# EasyEDA Pro project PR.eprj, schematic 新大符2.0 (continued)
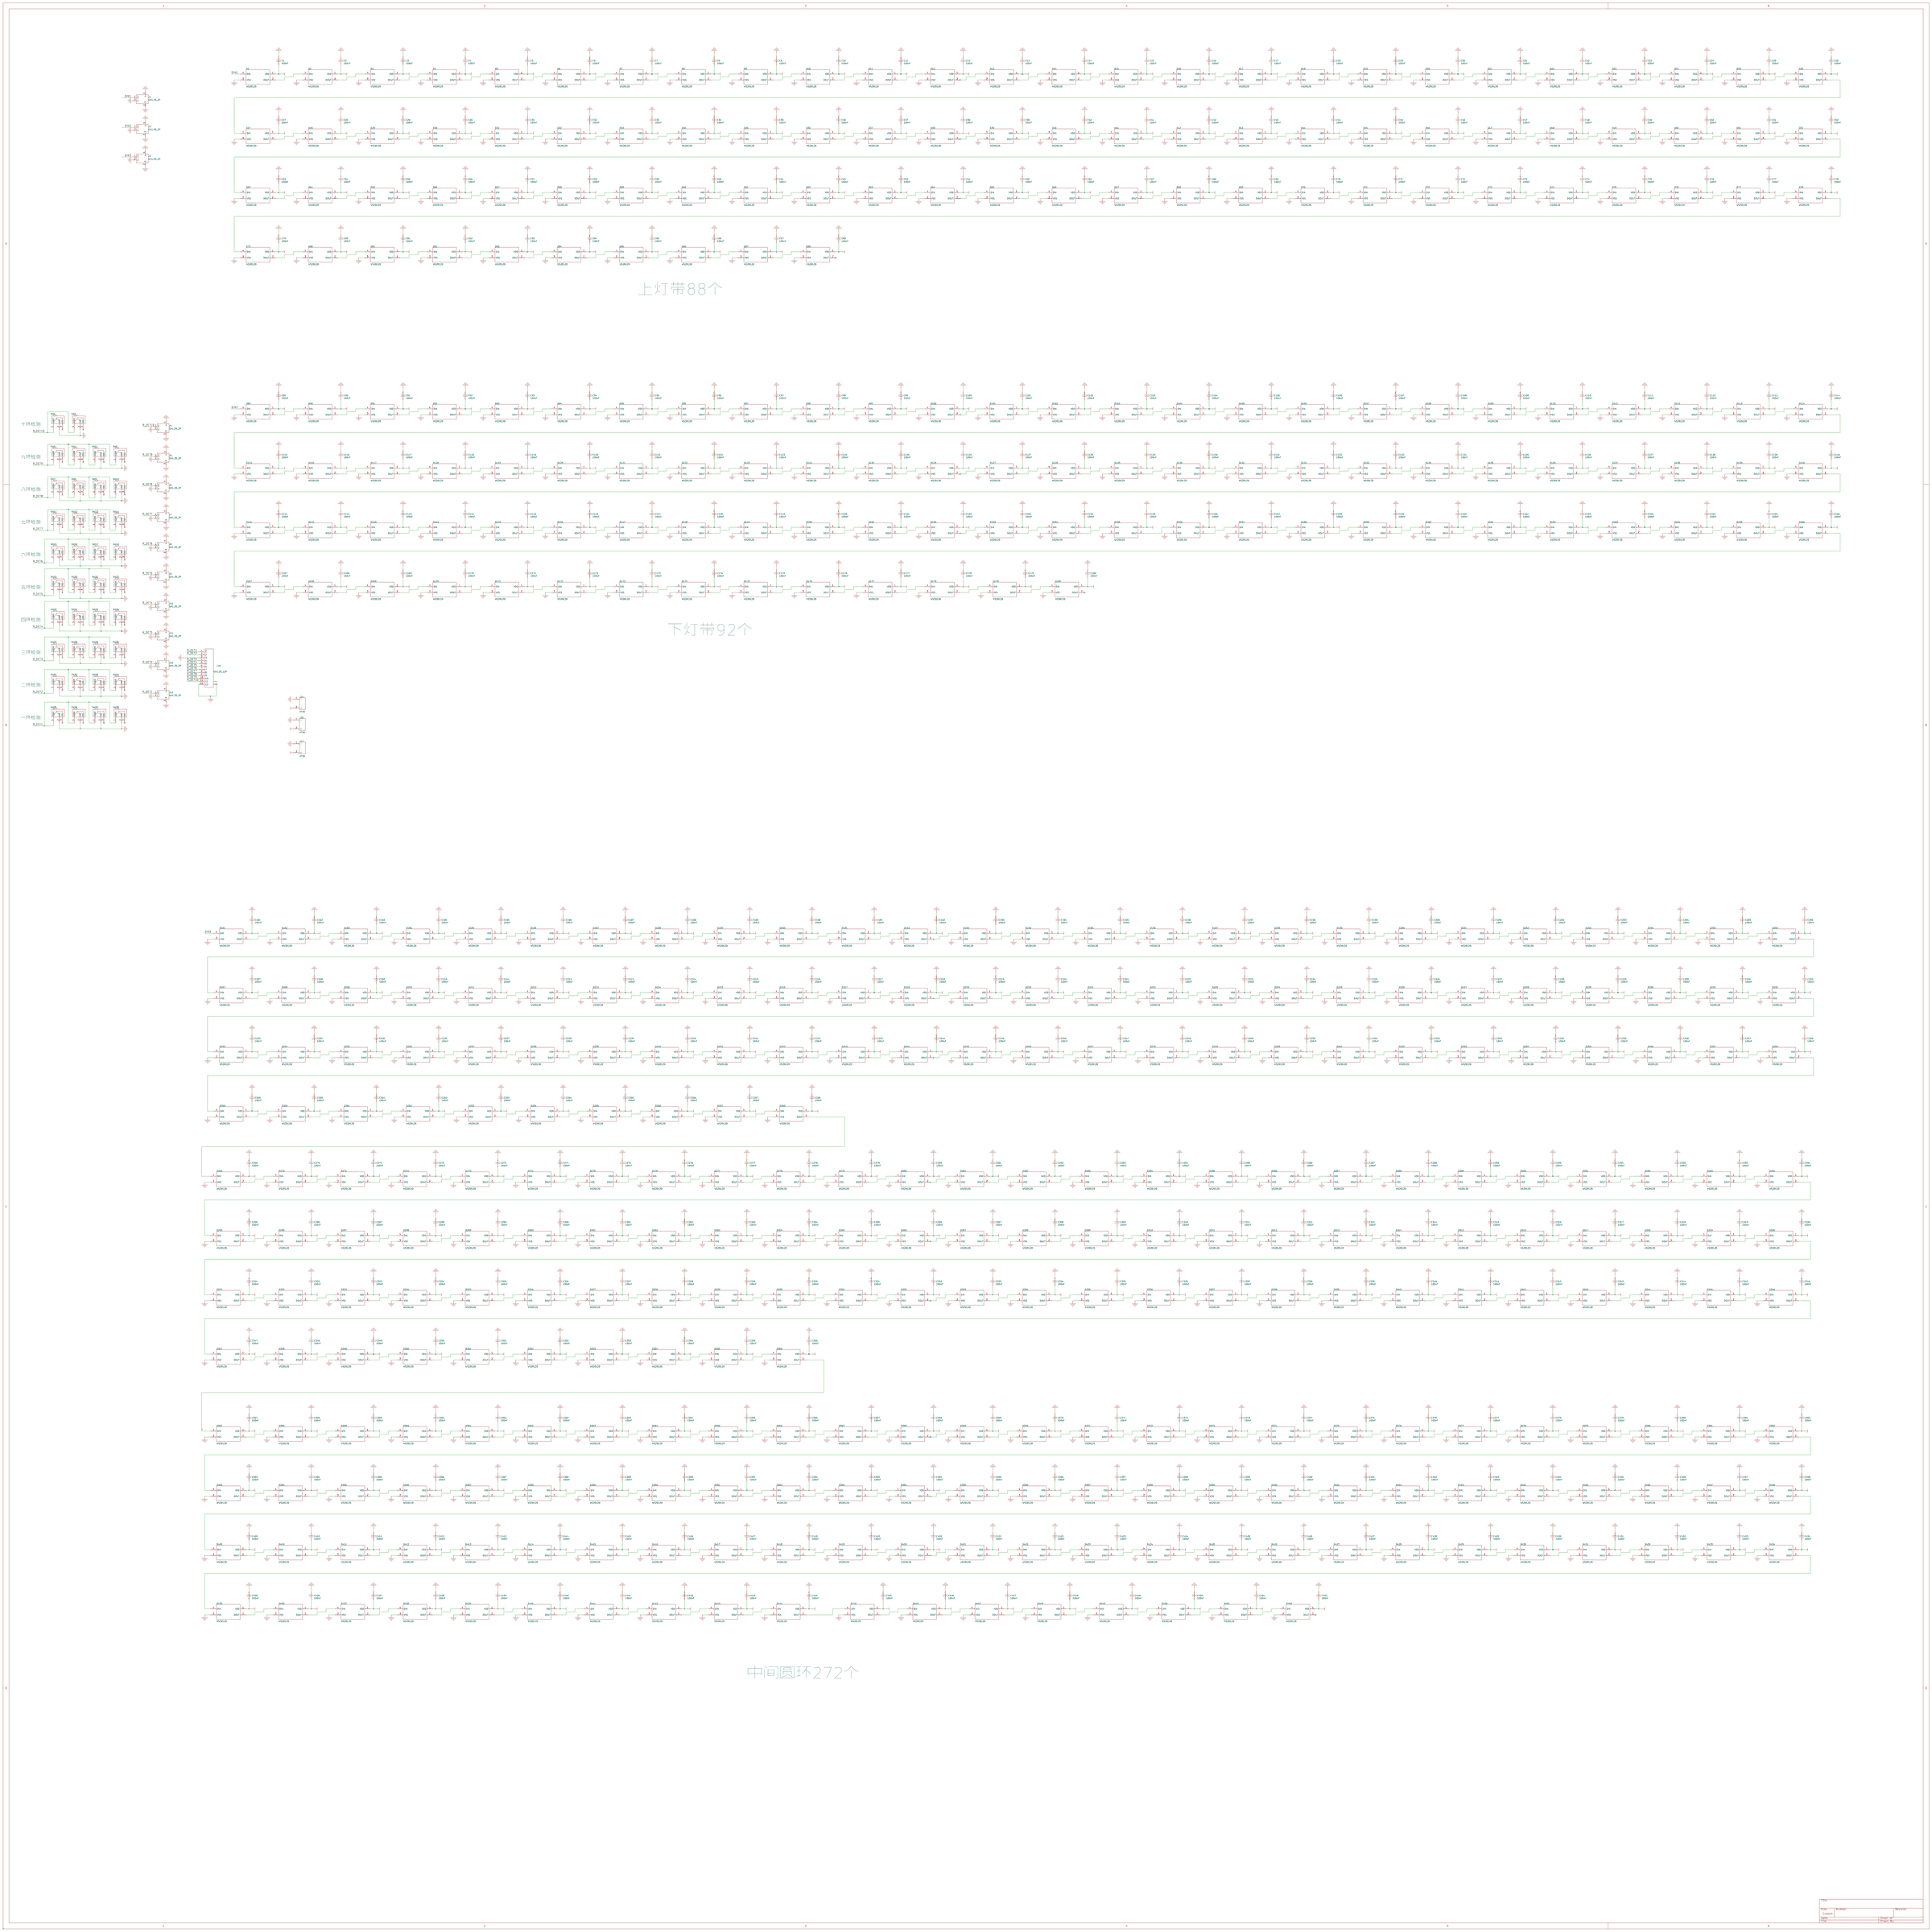
[diagram p0: schematic sheet]
## Nets (continued)
VCC: C1.1 C2.1 C3.1 C4.1 C5.1 C6.1 C7.1 C8.1 C9.1 C10.1 C11.1 C12.1 C13.1 C14.1 C15.1 C16.1 C17.1 C18.1 C19.1 C20.1 C21.1 C22.1 C23.1 C24.1 C25.1 C26.1 C27.1 C28.1 C29.1 C30.1 C31.1 C32.1 C33.1 C34.1 C35.1 C36.1 C37.1 C38.1 C39.1 C40.1 C41.1 C42.1 C43.1 C44.1 C45.1 C46.1 C47.1 C48.1 C49.1 C50.1 C51.1 C52.1 C53.1 C54.1 C55.1 C56.1 C57.1 C58.1 C59.1 C60.1 C61.1 C62.1 C63.1 C64.1 C65.1 C66.1 C67.1 C68.1 C69.1 C70.1 C71.1 C72.1 C73.1 C74.1 C75.1 C76.1 C77.1 C78.1 C79.1 C80.1 C81.1 C82.1 C83.1 C84.1 C85.1 C86.1 C87.1 C88.1 C89.1 C90.1 C91.1 C92.1 C93.1 C94.1 C95.1 C96.1 C97.1 C98.1 C99.1 C100.1 C101.1 C102.1 C103.1 C104.1 C105.1 C106.1 C107.1 C108.1 C109.1 C110.1 C111.1 C112.1 C113.1 C114.1 C115.1 C116.1 C117.1 C118.1 C119.1 C120.1 C121.1 C122.1 C123.1 C124.1 C125.1 C126.1 C127.1 C128.1 C129.1 C130.1 C131.1 C132.1 C133.1 C134.1 C135.1 C136.1 C137.1 C138.1 C139.1 C140.1 C141.1 C142.1 C143.1 C144.1 C145.1 C146.1 C147.1 C148.1 C149.1 C150.1 C151.1 C152.1 C153.1 C154.1 C155.1 C156.1 C157.1 C158.1 C159.1 C160.1 C161.1 C162.1 C163.1 C164.1 C165.1 C166.1 C167.1 C168.1 C169.1 C170.1 C171.1 C172.1 C173.1 C174.1 C175.1 C176.1 C177.1 C178.1 C179.1 C180.1 C181.1 C182.1 C183.1 C184.1 C185.1 C186.1 C187.1 C188.1 C189.1 C190.1 C191.1 C192.1 C193.1 C194.1 C195.1 C196.1 C197.1 C198.1 C199.1 C200.1 C201.1 C202.1 C203.1 C204.1 C205.1 C206.1 C207.1 C208.1 C209.1 C210.1 C211.1 C212.1 C213.1 C214.1 C215.1 C216.1 C217.1 C218.1 C219.1 C220.1 C221.1 C222.1 C223.1 C224.1 C225.1 C226.1 C227.1 C228.1 C229.1 C230.1 C231.1 C232.1 C233.1 C234.1 C235.1 C236.1 C237.1 C238.1 C239.1 C240.1 C241.1 C242.1 C243.1 C244.1 C245.1 C246.1 C247.1 C248.1 C249.1 C250.1 C251.1 C252.1 C253.1 C254.1 C255.1 C256.1 C257.1 C258.1 C259.1 C260.1 C261.1 C262.1 C263.1 C264.1 C265.1 C266.1 C267.1 C268.1 C269.1 C270.1 C271.1 C272.1 C273.1 C274.1 C275.1 C276.1 C277.1 C278.1 C279.1 C280.1 C281.1 C282.1 C283.1 C284.1 C285.1 C286.1 C287.1 C288.1 C289.1 C290.1 C291.1 C292.1 C293.1 C294.1 C295.1 C296.1 C297.1 C298.1 C299.1 C300.1 C301.1 C302.1 C303.1 C304.1 C305.1 C306.1 C307.1 C308.1 C309.1 C310.1 C311.1 C312.1 C313.1 C314.1 C315.1 C316.1 C317.1 C318.1 C319.1 C320.1 C321.1 C322.1 C323.1 C324.1 C325.1 C326.1 C327.1 C328.1 C329.1 C330.1 C331.1 C332.1 C333.1 C334.1 C335.1 C336.1 C337.1 C338.1 C339.1 C340.1 C341.1 C342.1 C343.1 C344.1 C345.1 C346.1 C347.1 C348.1 C349.1 C350.1 C351.1 C352.1 C353.1 C354.1 C355.1 C356.1 C357.1 C358.1 C359.1 C360.1 C361.1 C362.1 C363.1 C364.1 C365.1 C366.1 C367.1 C368.1 C369.1 C370.1 C371.1 C372.1 C373.1 C374.1 C375.1 C376.1 C377.1 C378.1 C379.1 C380.1 C381.1 C382.1 C383.1 C384.1 C385.1 C386.1 C387.1 C388.1 C389.1 C390.1 C391.1 C392.1 C393.1 C394.1 C395.1 C396.1 C397.1 C398.1 C399.1 C400.1 C401.1 C402.1 C403.1 C404.1 C405.1 C406.1 C407.1 C408.1 C409.1 C410.1 C411.1 C412.1 C413.1 C414.1 C415.1 C416.1 C417.1 C418.1 C419.1 C420.1 C421.1 C422.1 C423.1 C424.1 C425.1 C426.1 C427.1 C428.1 C429.1 C430.1 C431.1 C432.1 C433.1 C434.1 C435.1 C436.1 C437.1 C438.1 C439.1 C440.1 C441.1 C442.1 C443.1 C444.1 C445.1 C446.1 C447.1 C448.1 C449.1 C450.1 C451.1 C452.1 D1.1(VDD) D2.1(VDD) D3.1(VDD) D4.1(VDD) D5.1(VDD) D6.1(VDD) D7.1(VDD) D8.1(VDD) D9.1(VDD) D10.1(VDD) D11.1(VDD) D12.1(VDD) D13.1(VDD) D14.1(VDD) D15.1(VDD) D16.1(VDD) D17.1(VDD) D18.1(VDD) D19.1(VDD) D20.1(VDD) D21.1(VDD) D22.1(VDD) D23.1(VDD) D24.1(VDD) D25.1(VDD) D26.1(VDD) D27.1(VDD) D28.1(VDD) D29.1(VDD) D30.1(VDD) D31.1(VDD) D32.1(VDD) D33.1(VDD) D34.1(VDD) D35.1(VDD) D36.1(VDD) D37.1(VDD) D38.1(VDD) D39.1(VDD) D40.1(VDD) D41.1(VDD) D42.1(VDD) D43.1(VDD) D44.1(VDD) D45.1(VDD) D46.1(VDD) D47.1(VDD) D48.1(VDD) D49.1(VDD) D50.1(VDD) D51.1(VDD) D52.1(VDD) D53.1(VDD) D54.1(VDD) D55.1(VDD) D56.1(VDD) D57.1(VDD) D58.1(VDD) D59.1(VDD) D60.1(VDD) D61.1(VDD) D62.1(VDD) D63.1(VDD) D64.1(VDD) D65.1(VDD) D66.1(VDD) D67.1(VDD) D68.1(VDD) D69.1(VDD) D70.1(VDD) D71.1(VDD) D72.1(VDD) D73.1(VDD) D74.1(VDD) D75.1(VDD) D76.1(VDD) D77.1(VDD) D78.1(VDD) D79.1(VDD) D80.1(VDD) D81.1(VDD) D82.1(VDD) D83.1(VDD) D84.1(VDD) D85.1(VDD) D86.1(VDD) D87.1(VDD) D88.1(VDD) D89.1(VDD) D90.1(VDD) D91.1(VDD) D92.1(VDD) D93.1(VDD) D94.1(VDD) D95.1(VDD) D96.1(VDD) D97.1(VDD) D98.1(VDD) D99.1(VDD) D100.1(VDD) D101.1(VDD) D102.1(VDD) D103.1(VDD) D104.1(VDD) D105.1(VDD) D106.1(VDD) D107.1(VDD) D108.1(VDD) D109.1(VDD) D110.1(VDD) D111.1(VDD) D112.1(VDD) D113.1(VDD) D114.1(VDD) D115.1(VDD) D116.1(VDD) D117.1(VDD) D118.1(VDD) D119.1(VDD) D120.1(VDD) D121.1(VDD) D122.1(VDD) D123.1(VDD) D124.1(VDD) D125.1(VDD) D126.1(VDD) D127.1(VDD) D128.1(VDD) D129.1(VDD) D130.1(VDD) D131.1(VDD) D132.1(VDD) D133.1(VDD) D134.1(VDD) D135.1(VDD) D136.1(VDD) D137.1(VDD) D138.1(VDD) D139.1(VDD) D140.1(VDD) D141.1(VDD) D142.1(VDD) D143.1(VDD) D144.1(VDD) D145.1(VDD) D146.1(VDD) D147.1(VDD) D148.1(VDD) D149.1(VDD) D150.1(VDD) D151.1(VDD) D152.1(VDD) D153.1(VDD) D154.1(VDD) D155.1(VDD) D156.1(VDD) D157.1(VDD) D158.1(VDD) D159.1(VDD) D160.1(VDD) D161.1(VDD) D162.1(VDD) D163.1(VDD) D164.1(VDD) D165.1(VDD) D166.1(VDD) D167.1(VDD) D168.1(VDD) D169.1(VDD) D170.1(VDD) D171.1(VDD) D172.1(VDD) D173.1(VDD) D174.1(VDD) D175.1(VDD) D176.1(VDD) D177.1(VDD) D178.1(VDD) D179.1(VDD) D180.1(VDD) D181.1(VDD) D182.1(VDD) D183.1(VDD) D184.1(VDD) D185.1(VDD) D186.1(VDD) D187.1(VDD) D188.1(VDD) D189.1(VDD) D190.1(VDD) D191.1(VDD) D192.1(VDD) D193.1(VDD) D194.1(VDD) D195.1(VDD) D196.1(VDD) D197.1(VDD) D198.1(VDD) D199.1(VDD) D200.1(VDD) D201.1(VDD) D202.1(VDD) D203.1(VDD) D204.1(VDD) D205.1(VDD) D206.1(VDD) D207.1(VDD) D208.1(VDD) D209.1(VDD) D210.1(VDD) D211.1(VDD) D212.1(VDD) D213.1(VDD) D214.1(VDD) D215.1(VDD) D216.1(VDD) D217.1(VDD) D218.1(VDD) D219.1(VDD) D220.1(VDD) D221.1(VDD) D222.1(VDD) D223.1(VDD) D224.1(VDD) D225.1(VDD) D226.1(VDD) D227.1(VDD) D228.1(VDD) D229.1(VDD) D230.1(VDD) D231.1(VDD) D232.1(VDD) D233.1(VDD) D234.1(VDD) D235.1(VDD) D236.1(VDD) D237.1(VDD) D238.1(VDD) D239.1(VDD) D240.1(VDD) D241.1(VDD) D242.1(VDD) D243.1(VDD) D244.1(VDD) D245.1(VDD) D246.1(VDD) D247.1(VDD) D248.1(VDD) D249.1(VDD) D250.1(VDD) D251.1(VDD) D252.1(VDD) D253.1(VDD) D254.1(VDD) D255.1(VDD) D256.1(VDD) D257.1(VDD) D258.1(VDD) D259.1(VDD) D260.1(VDD) D261.1(VDD) D262.1(VDD) D263.1(VDD) D264.1(VDD) D265.1(VDD) D266.1(VDD) D267.1(VDD) D268.1(VDD) D269.1(VDD) D270.1(VDD) D271.1(VDD) D272.1(VDD) D273.1(VDD) D274.1(VDD) D275.1(VDD) D276.1(VDD) D277.1(VDD) D278.1(VDD) D279.1(VDD) D280.1(VDD) D281.1(VDD) D282.1(VDD) D283.1(VDD) D284.1(VDD) D285.1(VDD) D286.1(VDD) D287.1(VDD) D288.1(VDD) D289.1(VDD) D290.1(VDD) D291.1(VDD) D292.1(VDD) D293.1(VDD) D294.1(VDD) D295.1(VDD) D296.1(VDD) D297.1(VDD) D298.1(VDD) D299.1(VDD) D300.1(VDD) D301.1(VDD) D302.1(VDD) D303.1(VDD) D304.1(VDD) D305.1(VDD) D306.1(VDD) D307.1(VDD) D308.1(VDD) D309.1(VDD) D310.1(VDD) D311.1(VDD) D312.1(VDD) D313.1(VDD) D314.1(VDD) D315.1(VDD) D316.1(VDD) D317.1(VDD) D318.1(VDD) D319.1(VDD) D320.1(VDD) D321.1(VDD) D322.1(VDD) D323.1(VDD) D324.1(VDD) D325.1(VDD) D326.1(VDD) D327.1(VDD) D328.1(VDD) D329.1(VDD) D330.1(VDD) D331.1(VDD) D332.1(VDD) D333.1(VDD) D334.1(VDD) D335.1(VDD) D336.1(VDD) D337.1(VDD) D338.1(VDD) D339.1(VDD) D340.1(VDD) D341.1(VDD) D342.1(VDD) D343.1(VDD) D344.1(VDD) D345.1(VDD) D346.1(VDD) D347.1(VDD) D348.1(VDD) D349.1(VDD) D350.1(VDD) D351.1(VDD) D352.1(VDD) D353.1(VDD) D354.1(VDD) D355.1(VDD) D356.1(VDD) D357.1(VDD) D358.1(VDD) D359.1(VDD) D360.1(VDD) D361.1(VDD) D362.1(VDD) D363.1(VDD) D364.1(VDD) D365.1(VDD) D366.1(VDD) D367.1(VDD) D368.1(VDD) D369.1(VDD) D370.1(VDD) D371.1(VDD) D372.1(VDD) D373.1(VDD) D374.1(VDD) D375.1(VDD) D376.1(VDD) D377.1(VDD) D378.1(VDD) D379.1(VDD) D380.1(VDD) D381.1(VDD) D382.1(VDD) D383.1(VDD) D384.1(VDD) D385.1(VDD) D386.1(VDD) D387.1(VDD) D388.1(VDD) D389.1(VDD) D390.1(VDD) D391.1(VDD) D392.1(VDD) D393.1(VDD) D394.1(VDD) D395.1(VDD) D396.1(VDD) D397.1(VDD) D398.1(VDD) D399.1(VDD) D400.1(VDD) D401.1(VDD) D402.1(VDD) D403.1(VDD) D404.1(VDD) D405.1(VDD) D406.1(VDD) D407.1(VDD) D408.1(VDD) D409.1(VDD) D410.1(VDD) D411.1(VDD) D412.1(VDD) D413.1(VDD) D414.1(VDD) D415.1(VDD) D416.1(VDD) D417.1(VDD) D418.1(VDD) D419.1(VDD) D420.1(VDD) D421.1(VDD) D422.1(VDD) D423.1(VDD) D424.1(VDD) D425.1(VDD) D426.1(VDD) D427.1(VDD) D428.1(VDD) D429.1(VDD) D430.1(VDD) D431.1(VDD) D432.1(VDD) D433.1(VDD) D434.1(VDD) D435.1(VDD) D436.1(VDD) D437.1(VDD) D438.1(VDD) D439.1(VDD) D440.1(VDD) D441.1(VDD) D442.1(VDD) D443.1(VDD) D444.1(VDD) D445.1(VDD) D446.1(VDD) D447.1(VDD) D448.1(VDD) D449.1(VDD) D450.1(VDD) D451.1(VDD) D452.1(VDD) J14.2(+) J15.2(+) J17.2(+)
DIN1: D1.4(DIN) J1.1
DIN2: D89.4(DIN) J2.1
DIN3: D181.4(DIN) J3.1
I: D356.2(DOUT) D357.4(DIN)
R_DET1: J13.1 J18.1 SW35.1(COM) SW36.1(COM) SW37.1(COM) SW38.1(COM)
R_DET2: J12.1 J18.2 SW31.1(COM) SW32.1(COM) SW33.1(COM) SW34.1(COM)
R_DET3: J11.1 J18.4 SW27.1(COM) SW28.1(COM) SW29.1(COM) SW30.1(COM)
R_DET4: J10.1 J18.5 SW23.1(COM) SW24.1(COM) SW25.1(COM) SW26.1(COM)
R_DET5: J9.1 J18.6 SW19.1(COM) SW20.1(COM) SW21.1(COM) SW22.1(COM)
R_DET6: J8.1 J18.7 SW15.1(COM) SW16.1(COM) SW17.1(COM) SW18.1(COM)
R_DET7: J7.1 J18.8 SW11.1(COM) SW12.1(COM) SW13.1(COM) SW14.1(COM)
R_DET8: J6.1 J18.9 SW7.1(COM) SW8.1(COM) SW9.1(COM) SW10.1(COM)
R_DET9: J5.1 J18.10 SW3.1(COM) SW4.1(COM) SW5.1(COM) SW6.1(COM)
R_DET10: J4.1 J18.11 SW1.1(COM) SW2.1(COM)
NETD1_2: D1.2(DOUT) D2.4(DIN)
NETD2_2: D2.2(DOUT) D3.4(DIN)
NETD3_2: D3.2(DOUT) D4.4(DIN)
NETD4_2: D4.2(DOUT) D5.4(DIN)
NETD5_2: D5.2(DOUT) D6.4(DIN)
NETD6_2: D6.2(DOUT) D7.4(DIN)
NETD7_2: D7.2(DOUT) D8.4(DIN)
NETD8_2: D8.2(DOUT) D9.4(DIN)
NETD9_2: D9.2(DOUT) D10.4(DIN)
NETD10_2: D10.2(DOUT) D11.4(DIN)
NETD11_2: D11.2(DOUT) D12.4(DIN)
NETD12_2: D12.2(DOUT) D13.4(DIN)
NETD13_2: D13.2(DOUT) D14.4(DIN)
NETD14_2: D14.2(DOUT) D15.4(DIN)
NETD15_2: D15.2(DOUT) D16.4(DIN)
NETD16_2: D16.2(DOUT) D17.4(DIN)
NETD17_2: D17.2(DOUT) D18.4(DIN)
NETD18_2: D18.2(DOUT) D19.4(DIN)
NETD19_2: D19.2(DOUT) D20.4(DIN)
NETD20_2: D20.2(DOUT) D21.4(DIN)
NETD21_2: D21.2(DOUT) D22.4(DIN)
NETD22_2: D22.2(DOUT) D23.4(DIN)
NETD23_2: D23.2(DOUT) D24.4(DIN)
NETD24_2: D24.2(DOUT) D25.4(DIN)
NETD25_2: D25.2(DOUT) D26.4(DIN)
NETD26_2: D26.2(DOUT) D27.4(DIN)
NETD27_2: D27.2(DOUT) D28.4(DIN)
NETD28_2: D28.2(DOUT) D29.4(DIN)
NETD29_2: D29.2(DOUT) D30.4(DIN)
NETD30_2: D30.2(DOUT) D31.4(DIN)
NETD31_2: D31.2(DOUT) D32.4(DIN)
NETD32_2: D32.2(DOUT) D33.4(DIN)
NETD33_2: D33.2(DOUT) D34.4(DIN)
NETD34_2: D34.2(DOUT) D35.4(DIN)
NETD35_2: D35.2(DOUT) D36.4(DIN)
NETD36_2: D36.2(DOUT) D37.4(DIN)
NETD37_2: D37.2(DOUT) D38.4(DIN)
NETD38_2: D38.2(DOUT) D39.4(DIN)
NETD39_2: D39.2(DOUT) D40.4(DIN)
NETD40_2: D40.2(DOUT) D41.4(DIN)
NETD41_2: D41.2(DOUT) D42.4(DIN)
NETD42_2: D42.2(DOUT) D43.4(DIN)
NETD43_2: D43.2(DOUT) D44.4(DIN)
NETD44_2: D44.2(DOUT) D45.4(DIN)
NETD45_2: D45.2(DOUT) D46.4(DIN)
NETD46_2: D46.2(DOUT) D47.4(DIN)
NETD47_2: D47.2(DOUT) D48.4(DIN)
NETD48_2: D48.2(DOUT) D49.4(DIN)
NETD49_2: D49.2(DOUT) D50.4(DIN)
NETD50_2: D50.2(DOUT) D51.4(DIN)
NETD51_2: D51.2(DOUT) D52.4(DIN)
NETD52_2: D52.2(DOUT) D53.4(DIN)
NETD53_2: D53.2(DOUT) D54.4(DIN)
NETD54_2: D54.2(DOUT) D55.4(DIN)
NETD55_2: D55.2(DOUT) D56.4(DIN)
NETD56_2: D56.2(DOUT) D57.4(DIN)
NETD57_2: D57.2(DOUT) D58.4(DIN)
NETD58_2: D58.2(DOUT) D59.4(DIN)
NETD59_2: D59.2(DOUT) D60.4(DIN)
NETD60_2: D60.2(DOUT) D61.4(DIN)
NETD61_2: D61.2(DOUT) D62.4(DIN)
NETD62_2: D62.2(DOUT) D63.4(DIN)
NETD63_2: D63.2(DOUT) D64.4(DIN)
NETD64_2: D64.2(DOUT) D65.4(DIN)
NETD65_2: D65.2(DOUT) D66.4(DIN)
NETD66_2: D66.2(DOUT) D67.4(DIN)
NETD67_2: D67.2(DOUT) D68.4(DIN)
NETD68_2: D68.2(DOUT) D69.4(DIN)
NETD69_2: D69.2(DOUT) D70.4(DIN)
NETD70_2: D70.2(DOUT) D71.4(DIN)
NETD71_2: D71.2(DOUT) D72.4(DIN)
NETD72_2: D72.2(DOUT) D73.4(DIN)
NETD73_2: D73.2(DOUT) D74.4(DIN)
NETD74_2: D74.2(DOUT) D75.4(DIN)
NETD75_2: D75.2(DOUT) D76.4(DIN)
NETD76_2: D76.2(DOUT) D77.4(DIN)
NETD77_2: D77.2(DOUT) D78.4(DIN)
NETD78_2: D78.2(DOUT) D79.4(DIN)
NETD79_2: D79.2(DOUT) D80.4(DIN)
NETD80_2: D80.2(DOUT) D81.4(DIN)
NETD81_2: D81.2(DOUT) D82.4(DIN)
NETD82_2: D82.2(DOUT) D83.4(DIN)
NETD83_2: D83.2(DOUT) D84.4(DIN)
NETD84_2: D84.2(DOUT) D85.4(DIN)
NETD85_2: D85.2(DOUT) D86.4(DIN)
NETD86_2: D86.2(DOUT) D87.4(DIN)
NETD87_2: D87.2(DOUT) D88.4(DIN)
NETD89_2: D89.2(DOUT) D90.4(DIN)
NETD90_2: D90.2(DOUT) D91.4(DIN)
NETD91_2: D91.2(DOUT) D92.4(DIN)
NETD92_2: D92.2(DOUT) D93.4(DIN)
NETD93_2: D93.2(DOUT) D94.4(DIN)
NETD94_2: D94.2(DOUT) D95.4(DIN)
NETD95_2: D95.2(DOUT) D96.4(DIN)
NETD96_2: D96.2(DOUT) D97.4(DIN)
NETD97_2: D97.2(DOUT) D98.4(DIN)
NETD98_2: D98.2(DOUT) D99.4(DIN)
NETD99_2: D99.2(DOUT) D100.4(DIN)
NETD100_2: D100.2(DOUT) D101.4(DIN)
NETD101_2: D101.2(DOUT) D102.4(DIN)
NETD102_2: D102.2(DOUT) D103.4(DIN)
NETD103_2: D103.2(DOUT) D104.4(DIN)
NETD104_2: D104.2(DOUT) D105.4(DIN)
NETD105_2: D105.2(DOUT) D106.4(DIN)
NETD106_2: D106.2(DOUT) D107.4(DIN)
NETD107_2: D107.2(DOUT) D108.4(DIN)
NETD108_2: D108.2(DOUT) D109.4(DIN)
NETD109_2: D109.2(DOUT) D110.4(DIN)
NETD110_2: D110.2(DOUT) D111.4(DIN)
NETD111_2: D111.2(DOUT) D112.4(DIN)
NETD112_2: D112.2(DOUT) D113.4(DIN)
NETD113_2: D113.2(DOUT) D114.4(DIN)
NETD114_2: D114.2(DOUT) D115.4(DIN)
NETD115_2: D115.2(DOUT) D116.4(DIN)
NETD116_2: D116.2(DOUT) D117.4(DIN)
NETD117_2: D117.2(DOUT) D118.4(DIN)
NETD118_2: D118.2(DOUT) D119.4(DIN)
NETD119_2: D119.2(DOUT) D120.4(DIN)
NETD120_2: D120.2(DOUT) D121.4(DIN)
NETD121_2: D121.2(DOUT) D122.4(DIN)
NETD122_2: D122.2(DOUT) D123.4(DIN)
NETD123_2: D123.2(DOUT) D124.4(DIN)
NETD124_2: D124.2(DOUT) D125.4(DIN)
NETD125_2: D125.2(DOUT) D126.4(DIN)
NETD126_2: D126.2(DOUT) D127.4(DIN)
NETD127_2: D127.2(DOUT) D128.4(DIN)
NETD128_2: D128.2(DOUT) D129.4(DIN)
NETD129_2: D129.2(DOUT) D130.4(DIN)
NETD130_2: D130.2(DOUT) D131.4(DIN)
NETD131_2: D131.2(DOUT) D132.4(DIN)
NETD132_2: D132.2(DOUT) D133.4(DIN)
NETD133_2: D133.2(DOUT) D134.4(DIN)
NETD134_2: D134.2(DOUT) D135.4(DIN)
NETD135_2: D135.2(DOUT) D136.4(DIN)
NETD136_2: D136.2(DOUT) D137.4(DIN)
NETD137_2: D137.2(DOUT) D138.4(DIN)
NETD138_2: D138.2(DOUT) D139.4(DIN)
NETD139_2: D139.2(DOUT) D140.4(DIN)
NETD140_2: D140.2(DOUT) D141.4(DIN)
NETD141_2: D141.2(DOUT) D142.4(DIN)
NETD142_2: D142.2(DOUT) D143.4(DIN)
NETD143_2: D143.2(DOUT) D144.4(DIN)
NETD144_2: D144.2(DOUT) D145.4(DIN)
NETD145_2: D145.2(DOUT) D146.4(DIN)
NETD146_2: D146.2(DOUT) D147.4(DIN)
NETD147_2: D147.2(DOUT) D148.4(DIN)
NETD148_2: D148.2(DOUT) D149.4(DIN)
NETD149_2: D149.2(DOUT) D150.4(DIN)
NETD150_2: D150.2(DOUT) D151.4(DIN)
NETD151_2: D151.2(DOUT) D152.4(DIN)
NETD152_2: D152.2(DOUT) D153.4(DIN)
NETD153_2: D153.2(DOUT) D154.4(DIN)
NETD154_2: D154.2(DOUT) D155.4(DIN)
NETD155_2: D155.2(DOUT) D156.4(DIN)
NETD156_2: D156.2(DOUT) D157.4(DIN)
NETD157_2: D157.2(DOUT) D158.4(DIN)
NETD158_2: D158.2(DOUT) D159.4(DIN)
NETD159_2: D159.2(DOUT) D160.4(DIN)
NETD160_2: D160.2(DOUT) D161.4(DIN)
NETD161_2: D161.2(DOUT) D162.4(DIN)
NETD162_2: D162.2(DOUT) D163.4(DIN)
NETD163_2: D163.2(DOUT) D164.4(DIN)
NETD164_2: D164.2(DOUT) D165.4(DIN)
NETD165_2: D165.2(DOUT) D166.4(DIN)
NETD166_2: D166.2(DOUT) D167.4(DIN)
NETD167_2: D167.2(DOUT) D168.4(DIN)
NETD168_2: D168.2(DOUT) D169.4(DIN)
NETD169_2: D169.2(DOUT) D170.4(DIN)
NETD170_2: D170.2(DOUT) D171.4(DIN)
NETD171_2: D171.2(DOUT) D172.4(DIN)
NETD172_2: D172.2(DOUT) D173.4(DIN)
NETD173_2: D173.2(DOUT) D174.4(DIN)
NETD174_2: D174.2(DOUT) D175.4(DIN)
NETD175_2: D175.2(DOUT) D176.4(DIN)
NETD176_2: D176.2(DOUT) D177.4(DIN)
NETD177_2: D177.2(DOUT) D178.4(DIN)
NETD178_2: D178.2(DOUT) D179.4(DIN)
NETD179_2: D179.2(DOUT) D180.4(DIN)
NETD181_2: D181.2(DOUT) D182.4(DIN)
NETD182_2: D182.2(DOUT) D183.4(DIN)
NETD183_2: D183.2(DOUT) D184.4(DIN)
NETD184_2: D184.2(DOUT) D185.4(DIN)
NETD185_2: D185.2(DOUT) D186.4(DIN)
NETD186_2: D186.2(DOUT) D187.4(DIN)
NETD187_2: D187.2(DOUT) D188.4(DIN)
NETD188_2: D188.2(DOUT) D189.4(DIN)
NETD189_2: D189.2(DOUT) D190.4(DIN)
NETD190_2: D190.2(DOUT) D191.4(DIN)
NETD191_2: D191.2(DOUT) D192.4(DIN)
NETD192_2: D192.2(DOUT) D193.4(DIN)
NETD193_2: D193.2(DOUT) D194.4(DIN)
NETD194_2: D194.2(DOUT) D195.4(DIN)
NETD195_2: D195.2(DOUT) D196.4(DIN)
NETD196_2: D196.2(DOUT) D197.4(DIN)
NETD197_2: D197.2(DOUT) D198.4(DIN)
NETD198_2: D198.2(DOUT) D199.4(DIN)
NETD199_2: D199.2(DOUT) D200.4(DIN)
NETD200_2: D200.2(DOUT) D201.4(DIN)
NETD201_2: D201.2(DOUT) D202.4(DIN)
NETD202_2: D202.2(DOUT) D203.4(DIN)
NETD203_2: D203.2(DOUT) D204.4(DIN)
NETD204_2: D204.2(DOUT) D205.4(DIN)
NETD205_2: D205.2(DOUT) D206.4(DIN)
NETD206_2: D206.2(DOUT) D207.4(DIN)
NETD207_2: D207.2(DOUT) D208.4(DIN)
NETD208_2: D208.2(DOUT) D209.4(DIN)
NETD209_2: D209.2(DOUT) D210.4(DIN)
NETD210_2: D210.2(DOUT) D211.4(DIN)
NETD211_2: D211.2(DOUT) D212.4(DIN)
NETD212_2: D212.2(DOUT) D213.4(DIN)
NETD213_2: D213.2(DOUT) D214.4(DIN)
NETD214_2: D214.2(DOUT) D215.4(DIN)
NETD215_2: D215.2(DOUT) D216.4(DIN)
NETD216_2: D216.2(DOUT) D217.4(DIN)
NETD217_2: D217.2(DOUT) D218.4(DIN)
NETD218_2: D218.2(DOUT) D219.4(DIN)
NETD219_2: D219.2(DOUT) D220.4(DIN)
NETD220_2: D220.2(DOUT) D221.4(DIN)
NETD221_2: D221.2(DOUT) D222.4(DIN)
NETD222_2: D222.2(DOUT) D223.4(DIN)
NETD223_2: D223.2(DOUT) D224.4(DIN)
NETD224_2: D224.2(DOUT) D225.4(DIN)
NETD225_2: D225.2(DOUT) D226.4(DIN)
NETD226_2: D226.2(DOUT) D227.4(DIN)
NETD227_2: D227.2(DOUT) D228.4(DIN)
NETD228_2: D228.2(DOUT) D229.4(DIN)
NETD229_2: D229.2(DOUT) D230.4(DIN)
NETD230_2: D230.2(DOUT) D231.4(DIN)
NETD231_2: D231.2(DOUT) D232.4(DIN)
NETD232_2: D232.2(DOUT) D233.4(DIN)
NETD233_2: D233.2(DOUT) D234.4(DIN)
NETD234_2: D234.2(DOUT) D235.4(DIN)
NETD235_2: D235.2(DOUT) D236.4(DIN)
NETD236_2: D236.2(DOUT) D237.4(DIN)
NETD237_2: D237.2(DOUT) D238.4(DIN)
NETD238_2: D238.2(DOUT) D239.4(DIN)
NETD239_2: D239.2(DOUT) D240.4(DIN)
NETD240_2: D240.2(DOUT) D241.4(DIN)
NETD241_2: D241.2(DOUT) D242.4(DIN)
NETD242_2: D242.2(DOUT) D243.4(DIN)
NETD243_2: D243.2(DOUT) D244.4(DIN)
NETD244_2: D244.2(DOUT) D245.4(DIN)
NETD245_2: D245.2(DOUT) D246.4(DIN)
NETD246_2: D246.2(DOUT) D247.4(DIN)
NETD247_2: D247.2(DOUT) D248.4(DIN)
NETD248_2: D248.2(DOUT) D249.4(DIN)
NETD249_2: D249.2(DOUT) D250.4(DIN)
NETD250_2: D250.2(DOUT) D251.4(DIN)
NETD251_2: D251.2(DOUT) D252.4(DIN)
NETD252_2: D252.2(DOUT) D253.4(DIN)
NETD253_2: D253.2(DOUT) D254.4(DIN)
NETD254_2: D254.2(DOUT) D255.4(DIN)
NETD255_2: D255.2(DOUT) D256.4(DIN)
NETD256_2: D256.2(DOUT) D257.4(DIN)
NETD257_2: D257.2(DOUT) D258.4(DIN)
NETD258_2: D258.2(DOUT) D259.4(DIN)
NETD259_2: D259.2(DOUT) D260.4(DIN)
NETD260_2: D260.2(DOUT) D261.4(DIN)
NETD261_2: D261.2(DOUT) D262.4(DIN)
NETD262_2: D262.2(DOUT) D263.4(DIN)
NETD263_2: D263.2(DOUT) D264.4(DIN)
NETD264_2: D264.2(DOUT) D265.4(DIN)
NETD265_2: D265.2(DOUT) D266.4(DIN)
NETD266_2: D266.2(DOUT) D267.4(DIN)
NETD267_2: D267.2(DOUT) D268.4(DIN)
NETD268_2: D268.2(DOUT) D269.4(DIN)
NETD269_2: D269.2(DOUT) D270.4(DIN)
NETD270_2: D270.2(DOUT) D271.4(DIN)
NETD271_2: D271.2(DOUT) D272.4(DIN)
NETD272_2: D272.2(DOUT) D273.4(DIN)
NETD273_2: D273.2(DOUT) D274.4(DIN)
NETD274_2: D274.2(DOUT) D275.4(DIN)
NETD275_2: D275.2(DOUT) D276.4(DIN)
NETD276_2: D276.2(DOUT) D277.4(DIN)
NETD277_2: D277.2(DOUT) D278.4(DIN)
NETD278_2: D278.2(DOUT) D279.4(DIN)
NETD279_2: D279.2(DOUT) D280.4(DIN)
NETD280_2: D280.2(DOUT) D281.4(DIN)
NETD281_2: D281.2(DOUT) D282.4(DIN)
NETD282_2: D282.2(DOUT) D283.4(DIN)
NETD283_2: D283.2(DOUT) D284.4(DIN)
NETD284_2: D284.2(DOUT) D285.4(DIN)
NETD285_2: D285.2(DOUT) D286.4(DIN)
NETD286_2: D286.2(DOUT) D287.4(DIN)
NETD287_2: D287.2(DOUT) D288.4(DIN)
NETD288_2: D288.2(DOUT) D289.4(DIN)
NETD289_2: D289.2(DOUT) D290.4(DIN)
NETD290_2: D290.2(DOUT) D291.4(DIN)
NETD291_2: D291.2(DOUT) D292.4(DIN)
NETD292_2: D292.2(DOUT) D293.4(DIN)
NETD293_2: D293.2(DOUT) D294.4(DIN)
NETD294_2: D294.2(DOUT) D295.4(DIN)
NETD295_2: D295.2(DOUT) D296.4(DIN)
NETD296_2: D296.2(DOUT) D297.4(DIN)
NETD297_2: D297.2(DOUT) D298.4(DIN)
NETD298_2: D298.2(DOUT) D299.4(DIN)
NETD299_2: D299.2(DOUT) D300.4(DIN)
NETD300_2: D300.2(DOUT) D301.4(DIN)
NETD301_2: D301.2(DOUT) D302.4(DIN)
NETD302_2: D302.2(DOUT) D303.4(DIN)
NETD303_2: D303.2(DOUT) D304.4(DIN)
NETD304_2: D304.2(DOUT) D305.4(DIN)
NETD305_2: D305.2(DOUT) D306.4(DIN)
NETD306_2: D306.2(DOUT) D307.4(DIN)
NETD307_2: D307.2(DOUT) D308.4(DIN)
NETD308_2: D308.2(DOUT) D309.4(DIN)
NETD309_2: D309.2(DOUT) D310.4(DIN)
NETD310_2: D310.2(DOUT) D311.4(DIN)
NETD311_2: D311.2(DOUT) D312.4(DIN)
NETD312_2: D312.2(DOUT) D313.4(DIN)
NETD313_2: D313.2(DOUT) D314.4(DIN)
NETD314_2: D314.2(DOUT) D315.4(DIN)
NETD315_2: D315.2(DOUT) D316.4(DIN)
NETD316_2: D316.2(DOUT) D317.4(DIN)
NETD317_2: D317.2(DOUT) D318.4(DIN)
NETD318_2: D318.2(DOUT) D319.4(DIN)
NETD319_2: D319.2(DOUT) D320.4(DIN)
NETD320_2: D320.2(DOUT) D321.4(DIN)
NETD321_2: D321.2(DOUT) D322.4(DIN)
NETD322_2: D322.2(DOUT) D323.4(DIN)
NETD323_2: D323.2(DOUT) D324.4(DIN)
NETD324_2: D324.2(DOUT) D325.4(DIN)
NETD325_2: D325.2(DOUT) D326.4(DIN)
NETD326_2: D326.2(DOUT) D327.4(DIN)
NETD327_2: D327.2(DOUT) D328.4(DIN)
NETD328_2: D328.2(DOUT) D329.4(DIN)
NETD329_2: D329.2(DOUT) D330.4(DIN)
NETD330_2: D330.2(DOUT) D331.4(DIN)
NETD331_2: D331.2(DOUT) D332.4(DIN)
NETD332_2: D332.2(DOUT) D333.4(DIN)
NETD333_2: D333.2(DOUT) D334.4(DIN)
NETD334_2: D334.2(DOUT) D335.4(DIN)
NETD335_2: D335.2(DOUT) D336.4(DIN)
NETD336_2: D336.2(DOUT) D337.4(DIN)
NETD337_2: D337.2(DOUT) D338.4(DIN)
NETD338_2: D338.2(DOUT) D339.4(DIN)
NETD339_2: D339.2(DOUT) D340.4(DIN)
NETD340_2: D340.2(DOUT) D341.4(DIN)
NETD341_2: D341.2(DOUT) D342.4(DIN)
NETD342_2: D342.2(DOUT) D343.4(DIN)
NETD343_2: D343.2(DOUT) D344.4(DIN)
NETD344_2: D344.2(DOUT) D345.4(DIN)
NETD345_2: D345.2(DOUT) D346.4(DIN)
NETD346_2: D346.2(DOUT) D347.4(DIN)
NETD347_2: D347.2(DOUT) D348.4(DIN)
NETD348_2: D348.2(DOUT) D349.4(DIN)
NETD349_2: D349.2(DOUT) D350.4(DIN)
NETD350_2: D350.2(DOUT) D351.4(DIN)
NETD351_2: D351.2(DOUT) D352.4(DIN)
NETD352_2: D352.2(DOUT) D353.4(DIN)
NETD353_2: D353.2(DOUT) D354.4(DIN)
NETD354_2: D354.2(DOUT) D355.4(DIN)
NETD355_2: D355.2(DOUT) D356.4(DIN)
NETD357_2: D357.2(DOUT) D358.4(DIN)
NETD358_2: D358.2(DOUT) D359.4(DIN)
NETD359_2: D359.2(DOUT) D360.4(DIN)
NETD360_2: D360.2(DOUT) D361.4(DIN)
NETD361_2: D361.2(DOUT) D362.4(DIN)
NETD362_2: D362.2(DOUT) D363.4(DIN)
NETD363_2: D363.2(DOUT) D364.4(DIN)
NETD364_2: D364.2(DOUT) D365.4(DIN)
NETD365_2: D365.2(DOUT) D366.4(DIN)
NETD366_2: D366.2(DOUT) D367.4(DIN)
NETD367_2: D367.2(DOUT) D368.4(DIN)
NETD368_2: D368.2(DOUT) D369.4(DIN)
NETD369_2: D369.2(DOUT) D370.4(DIN)
NETD370_2: D370.2(DOUT) D371.4(DIN)
NETD371_2: D371.2(DOUT) D372.4(DIN)
NETD372_2: D372.2(DOUT) D373.4(DIN)
NETD373_2: D373.2(DOUT) D374.4(DIN)
NETD374_2: D374.2(DOUT) D375.4(DIN)
NETD375_2: D375.2(DOUT) D376.4(DIN)
NETD376_2: D376.2(DOUT) D377.4(DIN)
NETD377_2: D377.2(DOUT) D378.4(DIN)
NETD378_2: D378.2(DOUT) D379.4(DIN)
NETD379_2: D379.2(DOUT) D380.4(DIN)
NETD380_2: D380.2(DOUT) D381.4(DIN)
NETD381_2: D381.2(DOUT) D382.4(DIN)
NETD382_2: D382.2(DOUT) D383.4(DIN)
NETD383_2: D383.2(DOUT) D384.4(DIN)
NETD384_2: D384.2(DOUT) D385.4(DIN)
NETD385_2: D385.2(DOUT) D386.4(DIN)
NETD386_2: D386.2(DOUT) D387.4(DIN)
NETD387_2: D387.2(DOUT) D388.4(DIN)
NETD388_2: D388.2(DOUT) D389.4(DIN)
NETD389_2: D389.2(DOUT) D390.4(DIN)
NETD390_2: D390.2(DOUT) D391.4(DIN)
NETD391_2: D391.2(DOUT) D392.4(DIN)
NETD392_2: D392.2(DOUT) D393.4(DIN)
NETD393_2: D393.2(DOUT) D394.4(DIN)
NETD394_2: D394.2(DOUT) D395.4(DIN)
NETD395_2: D395.2(DOUT) D396.4(DIN)
NETD396_2: D396.2(DOUT) D397.4(DIN)
NETD397_2: D397.2(DOUT) D398.4(DIN)
NETD398_2: D398.2(DOUT) D399.4(DIN)
NETD399_2: D399.2(DOUT) D400.4(DIN)
NETD400_2: D400.2(DOUT) D401.4(DIN)
NETD401_2: D401.2(DOUT) D402.4(DIN)
NETD402_2: D402.2(DOUT) D403.4(DIN)
NETD403_2: D403.2(DOUT) D404.4(DIN)
NETD404_2: D404.2(DOUT) D405.4(DIN)
NETD405_2: D405.2(DOUT) D406.4(DIN)
NETD406_2: D406.2(DOUT) D407.4(DIN)
NETD407_2: D407.2(DOUT) D408.4(DIN)
NETD408_2: D408.2(DOUT) D409.4(DIN)
NETD409_2: D409.2(DOUT) D410.4(DIN)
NETD410_2: D410.2(DOUT) D411.4(DIN)
NETD411_2: D411.2(DOUT) D412.4(DIN)
NETD412_2: D412.2(DOUT) D413.4(DIN)
NETD413_2: D413.2(DOUT) D414.4(DIN)
NETD414_2: D414.2(DOUT) D415.4(DIN)
NETD415_2: D415.2(DOUT) D416.4(DIN)
NETD416_2: D416.2(DOUT) D417.4(DIN)
NETD417_2: D417.2(DOUT) D418.4(DIN)
NETD418_2: D418.2(DOUT) D419.4(DIN)
NETD419_2: D419.2(DOUT) D420.4(DIN)
NETD420_2: D420.2(DOUT) D421.4(DIN)
NETD421_2: D421.2(DOUT) D422.4(DIN)
NETD422_2: D422.2(DOUT) D423.4(DIN)
NETD423_2: D423.2(DOUT) D424.4(DIN)
NETD424_2: D424.2(DOUT) D425.4(DIN)
NETD425_2: D425.2(DOUT) D426.4(DIN)
NETD426_2: D426.2(DOUT) D427.4(DIN)
NETD427_2: D427.2(DOUT) D428.4(DIN)
NETD428_2: D428.2(DOUT) D429.4(DIN)
NETD429_2: D429.2(DOUT) D430.4(DIN)
NETD430_2: D430.2(DOUT) D431.4(DIN)
NETD431_2: D431.2(DOUT) D432.4(DIN)
NETD432_2: D432.2(DOUT) D433.4(DIN)
NETD433_2: D433.2(DOUT) D434.4(DIN)
NETD434_2: D434.2(DOUT) D435.4(DIN)
NETD435_2: D435.2(DOUT) D436.4(DIN)
NETD436_2: D436.2(DOUT) D437.4(DIN)
NETD437_2: D437.2(DOUT) D438.4(DIN)
NETD438_2: D438.2(DOUT) D439.4(DIN)
NETD439_2: D439.2(DOUT) D440.4(DIN)
NETD440_2: D440.2(DOUT) D441.4(DIN)
NETD441_2: D441.2(DOUT) D442.4(DIN)
NETD442_2: D442.2(DOUT) D443.4(DIN)
NETD443_2: D443.2(DOUT) D444.4(DIN)
NETD444_2: D444.2(DOUT) D445.4(DIN)
NETD445_2: D445.2(DOUT) D446.4(DIN)
NETD446_2: D446.2(DOUT) D447.4(DIN)
NETD447_2: D447.2(DOUT) D448.4(DIN)
NETD448_2: D448.2(DOUT) D449.4(DIN)
NETD449_2: D449.2(DOUT) D450.4(DIN)
NETD450_2: D450.2(DOUT) D451.4(DIN)
NETD451_2: D451.2(DOUT) D452.4(DIN)

Not connected (* = marked no-connect by the designer): D88 2(DOUT)*; D180 2(DOUT)*; D452 2(DOUT)*; SW1 3(NC)*; SW2 3(NC)*; SW3 3(NC)*; SW4 3(NC)*; SW5 3(NC)*; SW6 3(NC)*; SW7 3(NC)*; SW8 3(NC)*; SW9 3(NC)*; SW10 3(NC)*; SW11 3(NC)*; SW12 3(NC)*; SW13 3(NC)*; SW14 3(NC)*; SW15 3(NC)*; SW16 3(NC)*; SW17 3(NC)*; SW18 3(NC)*; SW19 3(NC)*; SW20 3(NC)*; SW21 3(NC)*; SW22 3(NC)*; SW23 3(NC)*; SW24 3(NC)*; SW25 3(NC)*; SW26 3(NC)*; SW27 3(NC)*; SW28 3(NC)*; SW29 3(NC)*; SW30 3(NC)*; SW31 3(NC)*; SW32 3(NC)*; SW33 3(NC)*; SW34 3(NC)*; SW35 3(NC)*; SW36 3(NC)*; SW37 3(NC)*; SW38 3(NC)*

## Notes on the sheet
- 上灯带88个
- 十环检测
- 九环检测
- 八环检测
- 七环检测
- 六环检测
- 五环检测
- 四环检测
- 下灯带92个
- 三环检测
- 二环检测
- 一环检测
- 中间圆环272个
